# EAGLE schematic Resistor_Resistor (EAGLE 8.3.0), part 19 of 43
## Parts (continued)
R25858  10K  RESISTOR_0201  [0201]
R25859  10K  RESISTOR_0201  [0201]
R25860  10K  RESISTOR_0201  [0201]
R25861  10K  RESISTOR_0201  [0201]
R25862  10K  RESISTOR_0201  [0201]
R25863  10K  RESISTOR_0201  [0201]
R25864  10K  RESISTOR_0201  [0201]
R25865  10K  RESISTOR_0201  [0201]
R25866  10K  RESISTOR_0201  [0201]
R25867  10K  RESISTOR_0201  [0201]
R25868  10K  RESISTOR_0201  [0201]
R25869  10K  RESISTOR_0201  [0201]
R25870  10K  RESISTOR_0201  [0201]
R25871  10K  RESISTOR_0201  [0201]
R25872  10K  RESISTOR_0201  [0201]
R25873  10K  RESISTOR_0201  [0201]
R25874  10K  RESISTOR_0201  [0201]
R25875  10K  RESISTOR_0201  [0201]
R25876  10K  RESISTOR_0201  [0201]
R25877  10K  RESISTOR_0201  [0201]
R25878  10K  RESISTOR_0201  [0201]
R25879  10K  RESISTOR_0201  [0201]
R25880  10K  RESISTOR_0201  [0201]
R25881  10K  RESISTOR_0201  [0201]
R25882  10K  RESISTOR_0201  [0201]
R25883  10K  RESISTOR_0201  [0201]
R25884  10K  RESISTOR_0201  [0201]
R25885  10K  RESISTOR_0201  [0201]
R25886  10K  RESISTOR_0201  [0201]
R25887  10K  RESISTOR_0201  [0201]
R25888  10K  RESISTOR_0201  [0201]
R25889  10K  RESISTOR_0201  [0201]
R25890  10K  RESISTOR_0201  [0201]
R25891  10K  RESISTOR_0201  [0201]
R25892  10K  RESISTOR_0201  [0201]
R25893  10K  RESISTOR_0201  [0201]
R25894  10K  RESISTOR_0201  [0201]
R25895  10K  RESISTOR_0201  [0201]
R25896  10K  RESISTOR_0201  [0201]
R25897  10K  RESISTOR_0201  [0201]
R25898  10K  RESISTOR_0201  [0201]
R25899  10K  RESISTOR_0201  [0201]
R25900  10K  RESISTOR_0201  [0201]
R25901  10K  RESISTOR_0201  [0201]
R25902  10K  RESISTOR_0201  [0201]
R25903  10K  RESISTOR_0201  [0201]
R25904  10K  RESISTOR_0201  [0201]
R25905  10K  RESISTOR_0201  [0201]
R25906  10K  RESISTOR_0201  [0201]
R25907  10K  RESISTOR_0201  [0201]
R25908  10K  RESISTOR_0201  [0201]
R25909  10K  RESISTOR_0201  [0201]
R25910  10K  RESISTOR_0201  [0201]
R25911  10K  RESISTOR_0201  [0201]
R25912  10K  RESISTOR_0201  [0201]
R25913  10K  RESISTOR_0201  [0201]
R25914  10K  RESISTOR_0201  [0201]
R25915  10K  RESISTOR_0201  [0201]
R25916  10K  RESISTOR_0201  [0201]
R25917  10K  RESISTOR_0201  [0201]
R25918  10K  RESISTOR_0201  [0201]
R25919  10K  RESISTOR_0201  [0201]
R25920  10K  RESISTOR_0201  [0201]
R25921  10K  RESISTOR_0201  [0201]
R25922  10K  RESISTOR_0201  [0201]
R25923  10K  RESISTOR_0201  [0201]
R25924  10K  RESISTOR_0201  [0201]
R25925  10K  RESISTOR_0201  [0201]
R25926  10K  RESISTOR_0201  [0201]
R25927  10K  RESISTOR_0201  [0201]
R25928  10K  RESISTOR_0201  [0201]
R25929  10K  RESISTOR_0201  [0201]
R25930  10K  RESISTOR_0201  [0201]
R25931  10K  RESISTOR_0201  [0201]
R25932  10K  RESISTOR_0201  [0201]
R25933  10K  RESISTOR_0201  [0201]
R25934  10K  RESISTOR_0201  [0201]
R25935  10K  RESISTOR_0201  [0201]
R25936  10K  RESISTOR_0201  [0201]
R25937  10K  RESISTOR_0201  [0201]
R25938  10K  RESISTOR_0201  [0201]
R25939  10K  RESISTOR_0201  [0201]
R25940  10K  RESISTOR_0201  [0201]
R25941  10K  RESISTOR_0201  [0201]
R25942  10K  RESISTOR_0201  [0201]
R25943  10K  RESISTOR_0201  [0201]
R25944  10K  RESISTOR_0201  [0201]
R25945  10K  RESISTOR_0201  [0201]
R25946  10K  RESISTOR_0201  [0201]
R25947  10K  RESISTOR_0201  [0201]
R25948  10K  RESISTOR_0201  [0201]
R25949  10K  RESISTOR_0201  [0201]
R25950  10K  RESISTOR_0201  [0201]
R25951  10K  RESISTOR_0201  [0201]
R25952  10K  RESISTOR_0201  [0201]
R25953  10K  RESISTOR_0201  [0201]
R25954  10K  RESISTOR_0201  [0201]
R25955  10K  RESISTOR_0201  [0201]
R25956  10K  RESISTOR_0201  [0201]
R25957  10K  RESISTOR_0201  [0201]
R25958  10K  RESISTOR_0201  [0201]
R25959  10K  RESISTOR_0201  [0201]
R25960  10K  RESISTOR_0201  [0201]
R25961  10K  RESISTOR_0201  [0201]
R25962  10K  RESISTOR_0201  [0201]
R25963  10K  RESISTOR_0201  [0201]
R25964  10K  RESISTOR_0201  [0201]
R25965  10K  RESISTOR_0201  [0201]
R25966  10K  RESISTOR_0201  [0201]
R25967  10K  RESISTOR_0201  [0201]
R25968  10K  RESISTOR_0201  [0201]
R25969  10K  RESISTOR_0201  [0201]
R25970  10K  RESISTOR_0201  [0201]
R25971  10K  RESISTOR_0201  [0201]
R25972  10K  RESISTOR_0201  [0201]
R25973  10K  RESISTOR_0201  [0201]
R25974  10K  RESISTOR_0201  [0201]
R25975  10K  RESISTOR_0201  [0201]
R25976  10K  RESISTOR_0201  [0201]
R25977  10K  RESISTOR_0201  [0201]
R25978  10K  RESISTOR_0201  [0201]
R25979  10K  RESISTOR_0201  [0201]
R25980  10K  RESISTOR_0201  [0201]
R25981  10K  RESISTOR_0201  [0201]
R25982  10K  RESISTOR_0201  [0201]
R25983  10K  RESISTOR_0201  [0201]
R25984  10K  RESISTOR_0201  [0201]
R25985  10K  RESISTOR_0201  [0201]
R25986  10K  RESISTOR_0201  [0201]
R25987  10K  RESISTOR_0201  [0201]
R25988  10K  RESISTOR_0201  [0201]
R25989  10K  RESISTOR_0201  [0201]
R25990  10K  RESISTOR_0201  [0201]
R25991  10K  RESISTOR_0201  [0201]
R25992  10K  RESISTOR_0201  [0201]
R25993  10K  RESISTOR_0201  [0201]
R25994  10K  RESISTOR_0201  [0201]
R25995  10K  RESISTOR_0201  [0201]
R25996  10K  RESISTOR_0201  [0201]
R25997  10K  RESISTOR_0201  [0201]
R25998  10K  RESISTOR_0201  [0201]
R25999  10K  RESISTOR_0201  [0201]
R26000  10K  RESISTOR_0201  [0201]
R26001  10K  RESISTOR_0201  [0201]
R26002  10K  RESISTOR_0201  [0201]
R26003  10K  RESISTOR_0201  [0201]
R26004  10K  RESISTOR_0201  [0201]
R26005  10K  RESISTOR_0201  [0201]
R26006  10K  RESISTOR_0201  [0201]
R26007  10K  RESISTOR_0201  [0201]
R26008  10K  RESISTOR_0201  [0201]
R26009  10K  RESISTOR_0201  [0201]
R26010  10K  RESISTOR_0201  [0201]
R26011  10K  RESISTOR_0201  [0201]
R26012  10K  RESISTOR_0201  [0201]
R26013  10K  RESISTOR_0201  [0201]
R26014  10K  RESISTOR_0201  [0201]
R26015  10K  RESISTOR_0201  [0201]
R26016  10K  RESISTOR_0201  [0201]
R26017  10K  RESISTOR_0201  [0201]
R26018  10K  RESISTOR_0201  [0201]
R26019  10K  RESISTOR_0201  [0201]
R26020  10K  RESISTOR_0201  [0201]
R26021  10K  RESISTOR_0201  [0201]
R26022  10K  RESISTOR_0201  [0201]
R26023  10K  RESISTOR_0201  [0201]
R26024  10K  RESISTOR_0201  [0201]
R26025  10K  RESISTOR_0201  [0201]
R26026  10K  RESISTOR_0201  [0201]
R26027  10K  RESISTOR_0201  [0201]
R26028  10K  RESISTOR_0201  [0201]
R26029  10K  RESISTOR_0201  [0201]
R26030  10K  RESISTOR_0201  [0201]
R26031  10K  RESISTOR_0201  [0201]
R26032  10K  RESISTOR_0201  [0201]
R26033  10K  RESISTOR_0201  [0201]
R26034  10K  RESISTOR_0201  [0201]
R26035  10K  RESISTOR_0201  [0201]
R26036  10K  RESISTOR_0201  [0201]
R26037  10K  RESISTOR_0201  [0201]
R26038  10K  RESISTOR_0201  [0201]
R26039  10K  RESISTOR_0201  [0201]
R26040  10K  RESISTOR_0201  [0201]
R26041  10K  RESISTOR_0201  [0201]
R26042  10K  RESISTOR_0201  [0201]
R26043  10K  RESISTOR_0201  [0201]
R26044  10K  RESISTOR_0201  [0201]
R26045  10K  RESISTOR_0201  [0201]
R26046  10K  RESISTOR_0201  [0201]
R26047  10K  RESISTOR_0201  [0201]
R26048  10K  RESISTOR_0201  [0201]
R26049  10K  RESISTOR_0201  [0201]
R26050  10K  RESISTOR_0201  [0201]
R26051  10K  RESISTOR_0201  [0201]
R26052  10K  RESISTOR_0201  [0201]
R26053  10K  RESISTOR_0201  [0201]
R26054  10K  RESISTOR_0201  [0201]
R26055  10K  RESISTOR_0201  [0201]
R26056  10K  RESISTOR_0201  [0201]
R26057  10K  RESISTOR_0201  [0201]
R26058  10K  RESISTOR_0201  [0201]
R26059  10K  RESISTOR_0201  [0201]
R26060  10K  RESISTOR_0201  [0201]
R26061  10K  RESISTOR_0201  [0201]
R26062  10K  RESISTOR_0201  [0201]
R26063  10K  RESISTOR_0201  [0201]
R26064  10K  RESISTOR_0201  [0201]
R26065  10K  RESISTOR_0201  [0201]
R26066  10K  RESISTOR_0201  [0201]
R26067  10K  RESISTOR_0201  [0201]
R26068  10K  RESISTOR_0201  [0201]
R26069  10K  RESISTOR_0201  [0201]
R26070  10K  RESISTOR_0201  [0201]
R26071  10K  RESISTOR_0201  [0201]
R26072  10K  RESISTOR_0201  [0201]
R26073  10K  RESISTOR_0201  [0201]
R26074  10K  RESISTOR_0201  [0201]
R26075  10K  RESISTOR_0201  [0201]
R26076  10K  RESISTOR_0201  [0201]
R26077  10K  RESISTOR_0201  [0201]
R26078  10K  RESISTOR_0201  [0201]
R26079  10K  RESISTOR_0201  [0201]
R26080  10K  RESISTOR_0201  [0201]
R26081  10K  RESISTOR_0201  [0201]
R26082  10K  RESISTOR_0201  [0201]
R26083  10K  RESISTOR_0201  [0201]
R26084  10K  RESISTOR_0201  [0201]
R26085  10K  RESISTOR_0201  [0201]
R26086  10K  RESISTOR_0201  [0201]
R26087  10K  RESISTOR_0201  [0201]
R26088  10K  RESISTOR_0201  [0201]
R26089  10K  RESISTOR_0201  [0201]
R26090  10K  RESISTOR_0201  [0201]
R26091  10K  RESISTOR_0201  [0201]
R26092  10K  RESISTOR_0201  [0201]
R26093  10K  RESISTOR_0201  [0201]
R26094  10K  RESISTOR_0201  [0201]
R26095  10K  RESISTOR_0201  [0201]
R26096  10K  RESISTOR_0201  [0201]
R26097  10K  RESISTOR_0201  [0201]
R26098  10K  RESISTOR_0201  [0201]
R26099  10K  RESISTOR_0201  [0201]
R26100  10K  RESISTOR_0201  [0201]
R26101  10K  RESISTOR_0201  [0201]
R26102  10K  RESISTOR_0201  [0201]
R26103  10K  RESISTOR_0201  [0201]
R26104  10K  RESISTOR_0201  [0201]
R26105  10K  RESISTOR_0201  [0201]
R26106  10K  RESISTOR_0201  [0201]
R26107  10K  RESISTOR_0201  [0201]
R26108  10K  RESISTOR_0201  [0201]
R26109  10K  RESISTOR_0201  [0201]
R26110  10K  RESISTOR_0201  [0201]
R26111  10K  RESISTOR_0201  [0201]
R26112  10K  RESISTOR_0201  [0201]
R26113  10K  RESISTOR_0201  [0201]
R26114  10K  RESISTOR_0201  [0201]
R26115  10K  RESISTOR_0201  [0201]
R26116  10K  RESISTOR_0201  [0201]
R26117  10K  RESISTOR_0201  [0201]
R26118  10K  RESISTOR_0201  [0201]
R26119  10K  RESISTOR_0201  [0201]
R26120  10K  RESISTOR_0201  [0201]
R26121  10K  RESISTOR_0201  [0201]
R26122  10K  RESISTOR_0201  [0201]
R26123  10K  RESISTOR_0201  [0201]
R26124  10K  RESISTOR_0201  [0201]
R26125  10K  RESISTOR_0201  [0201]
R26126  10K  RESISTOR_0201  [0201]
R26127  10K  RESISTOR_0201  [0201]
R26128  10K  RESISTOR_0201  [0201]
R26129  10K  RESISTOR_0201  [0201]
R26130  10K  RESISTOR_0201  [0201]
R26131  10K  RESISTOR_0201  [0201]
R26132  10K  RESISTOR_0201  [0201]
R26133  10K  RESISTOR_0201  [0201]
R26134  10K  RESISTOR_0201  [0201]
R26135  10K  RESISTOR_0201  [0201]
R26136  10K  RESISTOR_0201  [0201]
R26137  10K  RESISTOR_0201  [0201]
R26138  10K  RESISTOR_0201  [0201]
R26139  10K  RESISTOR_0201  [0201]
R26140  10K  RESISTOR_0201  [0201]
R26141  10K  RESISTOR_0201  [0201]
R26142  10K  RESISTOR_0201  [0201]
R26143  10K  RESISTOR_0201  [0201]
R26144  10K  RESISTOR_0201  [0201]
R26145  10K  RESISTOR_0201  [0201]
R26146  10K  RESISTOR_0201  [0201]
R26147  10K  RESISTOR_0201  [0201]
R26148  10K  RESISTOR_0201  [0201]
R26149  10K  RESISTOR_0201  [0201]
R26150  10K  RESISTOR_0201  [0201]
R26151  10K  RESISTOR_0201  [0201]
R26152  10K  RESISTOR_0201  [0201]
R26153  10K  RESISTOR_0201  [0201]
R26154  10K  RESISTOR_0201  [0201]
R26155  10K  RESISTOR_0201  [0201]
R26156  10K  RESISTOR_0201  [0201]
R26157  10K  RESISTOR_0201  [0201]
R26158  10K  RESISTOR_0201  [0201]
R26159  10K  RESISTOR_0201  [0201]
R26160  10K  RESISTOR_0201  [0201]
R26161  10K  RESISTOR_0201  [0201]
R26162  10K  RESISTOR_0201  [0201]
R26163  10K  RESISTOR_0201  [0201]
R26164  10K  RESISTOR_0201  [0201]
R26165  10K  RESISTOR_0201  [0201]
R26166  10K  RESISTOR_0201  [0201]
R26167  10K  RESISTOR_0201  [0201]
R26168  10K  RESISTOR_0201  [0201]
R26169  10K  RESISTOR_0201  [0201]
R26170  10K  RESISTOR_0201  [0201]
R26171  10K  RESISTOR_0201  [0201]
R26172  10K  RESISTOR_0201  [0201]
R26173  10K  RESISTOR_0201  [0201]
R26174  10K  RESISTOR_0201  [0201]
R26175  10K  RESISTOR_0201  [0201]
R26176  10K  RESISTOR_0201  [0201]
R26177  10K  RESISTOR_0201  [0201]
R26178  10K  RESISTOR_0201  [0201]
R26179  10K  RESISTOR_0201  [0201]
R26180  10K  RESISTOR_0201  [0201]
R26181  10K  RESISTOR_0201  [0201]
R26182  10K  RESISTOR_0201  [0201]
R26183  10K  RESISTOR_0201  [0201]
R26184  10K  RESISTOR_0201  [0201]
R26185  10K  RESISTOR_0201  [0201]
R26186  10K  RESISTOR_0201  [0201]
R26187  10K  RESISTOR_0201  [0201]
R26188  10K  RESISTOR_0201  [0201]
R26189  10K  RESISTOR_0201  [0201]
R26190  10K  RESISTOR_0201  [0201]
R26191  10K  RESISTOR_0201  [0201]
R26192  10K  RESISTOR_0201  [0201]
R26193  10K  RESISTOR_0201  [0201]
R26194  10K  RESISTOR_0201  [0201]
R26195  10K  RESISTOR_0201  [0201]
R26196  10K  RESISTOR_0201  [0201]
R26197  10K  RESISTOR_0201  [0201]
R26198  10K  RESISTOR_0201  [0201]
R26199  10K  RESISTOR_0201  [0201]
R26200  10K  RESISTOR_0201  [0201]
R26201  10K  RESISTOR_0201  [0201]
R26202  10K  RESISTOR_0201  [0201]
R26203  10K  RESISTOR_0201  [0201]
R26204  10K  RESISTOR_0201  [0201]
R26205  10K  RESISTOR_0201  [0201]
R26206  10K  RESISTOR_0201  [0201]
R26207  10K  RESISTOR_0201  [0201]
R26208  10K  RESISTOR_0201  [0201]
R26209  10K  RESISTOR_0201  [0201]
R26210  10K  RESISTOR_0201  [0201]
R26211  10K  RESISTOR_0201  [0201]
R26212  10K  RESISTOR_0201  [0201]
R26213  10K  RESISTOR_0201  [0201]
R26214  10K  RESISTOR_0201  [0201]
R26215  10K  RESISTOR_0201  [0201]
R26216  10K  RESISTOR_0201  [0201]
R26217  10K  RESISTOR_0201  [0201]
R26218  10K  RESISTOR_0201  [0201]
R26219  10K  RESISTOR_0201  [0201]
R26220  10K  RESISTOR_0201  [0201]
R26221  10K  RESISTOR_0201  [0201]
R26222  10K  RESISTOR_0201  [0201]
R26223  10K  RESISTOR_0201  [0201]
R26224  10K  RESISTOR_0201  [0201]
R26225  10K  RESISTOR_0201  [0201]
R26226  10K  RESISTOR_0201  [0201]
R26227  10K  RESISTOR_0201  [0201]
R26228  10K  RESISTOR_0201  [0201]
R26229  10K  RESISTOR_0201  [0201]
R26230  10K  RESISTOR_0201  [0201]
R26231  10K  RESISTOR_0201  [0201]
R26232  10K  RESISTOR_0201  [0201]
R26233  10K  RESISTOR_0201  [0201]
R26234  10K  RESISTOR_0201  [0201]
R26235  10K  RESISTOR_0201  [0201]
R26236  10K  RESISTOR_0201  [0201]
R26237  10K  RESISTOR_0201  [0201]
R26238  10K  RESISTOR_0201  [0201]
R26239  10K  RESISTOR_0201  [0201]
R26240  10K  RESISTOR_0201  [0201]
R26241  10K  RESISTOR_0201  [0201]
R26242  10K  RESISTOR_0201  [0201]
R26243  10K  RESISTOR_0201  [0201]
R26244  10K  RESISTOR_0201  [0201]
R26245  10K  RESISTOR_0201  [0201]
R26246  10K  RESISTOR_0201  [0201]
R26247  10K  RESISTOR_0201  [0201]
R26248  10K  RESISTOR_0201  [0201]
R26249  10K  RESISTOR_0201  [0201]
R26250  10K  RESISTOR_0201  [0201]
R26251  10K  RESISTOR_0201  [0201]
R26252  10K  RESISTOR_0201  [0201]
R26253  10K  RESISTOR_0201  [0201]
R26254  10K  RESISTOR_0201  [0201]
R26255  10K  RESISTOR_0201  [0201]
R26256  10K  RESISTOR_0201  [0201]
R26257  10K  RESISTOR_0201  [0201]
R26258  10K  RESISTOR_0201  [0201]
R26259  10K  RESISTOR_0201  [0201]
R26260  10K  RESISTOR_0201  [0201]
R26261  10K  RESISTOR_0201  [0201]
R26262  10K  RESISTOR_0201  [0201]
R26263  10K  RESISTOR_0201  [0201]
R26264  10K  RESISTOR_0201  [0201]
R26265  10K  RESISTOR_0201  [0201]
R26266  10K  RESISTOR_0201  [0201]
R26267  10K  RESISTOR_0201  [0201]
R26268  10K  RESISTOR_0201  [0201]
R26269  10K  RESISTOR_0201  [0201]
R26270  10K  RESISTOR_0201  [0201]
R26271  10K  RESISTOR_0201  [0201]
R26272  10K  RESISTOR_0201  [0201]
R26273  10K  RESISTOR_0201  [0201]
R26274  10K  RESISTOR_0201  [0201]
R26275  10K  RESISTOR_0201  [0201]
R26276  10K  RESISTOR_0201  [0201]
R26277  10K  RESISTOR_0201  [0201]
R26278  10K  RESISTOR_0201  [0201]
R26279  10K  RESISTOR_0201  [0201]
R26280  10K  RESISTOR_0201  [0201]
R26281  10K  RESISTOR_0201  [0201]
R26282  10K  RESISTOR_0201  [0201]
R26283  10K  RESISTOR_0201  [0201]
R26284  10K  RESISTOR_0201  [0201]
R26285  10K  RESISTOR_0201  [0201]
R26286  10K  RESISTOR_0201  [0201]
R26287  10K  RESISTOR_0201  [0201]
R26288  10K  RESISTOR_0201  [0201]
R26289  10K  RESISTOR_0201  [0201]
R26290  10K  RESISTOR_0201  [0201]
R26291  10K  RESISTOR_0201  [0201]
R26292  10K  RESISTOR_0201  [0201]
R26293  10K  RESISTOR_0201  [0201]
R26294  10K  RESISTOR_0201  [0201]
R26295  10K  RESISTOR_0201  [0201]
R26296  10K  RESISTOR_0201  [0201]
R26297  10K  RESISTOR_0201  [0201]
R26298  10K  RESISTOR_0201  [0201]
R26299  10K  RESISTOR_0201  [0201]
R26300  10K  RESISTOR_0201  [0201]
R26301  10K  RESISTOR_0201  [0201]
R26302  10K  RESISTOR_0201  [0201]
R26303  10K  RESISTOR_0201  [0201]
R26304  10K  RESISTOR_0201  [0201]
R26305  10K  RESISTOR_0201  [0201]
R26306  10K  RESISTOR_0201  [0201]
R26307  10K  RESISTOR_0201  [0201]
R26308  10K  RESISTOR_0201  [0201]
R26309  10K  RESISTOR_0201  [0201]
R26310  10K  RESISTOR_0201  [0201]
R26311  10K  RESISTOR_0201  [0201]
R26312  10K  RESISTOR_0201  [0201]
R26313  10K  RESISTOR_0201  [0201]
R26314  10K  RESISTOR_0201  [0201]
R26315  10K  RESISTOR_0201  [0201]
R26316  10K  RESISTOR_0201  [0201]
R26317  10K  RESISTOR_0201  [0201]
R26318  10K  RESISTOR_0201  [0201]
R26319  10K  RESISTOR_0201  [0201]
R26320  10K  RESISTOR_0201  [0201]
R26321  10K  RESISTOR_0201  [0201]
R26322  10K  RESISTOR_0201  [0201]
R26323  10K  RESISTOR_0201  [0201]
R26324  10K  RESISTOR_0201  [0201]
R26325  10K  RESISTOR_0201  [0201]
R26326  10K  RESISTOR_0201  [0201]
R26327  10K  RESISTOR_0201  [0201]
R26328  10K  RESISTOR_0201  [0201]
R26329  10K  RESISTOR_0201  [0201]
R26330  10K  RESISTOR_0201  [0201]
R26331  10K  RESISTOR_0201  [0201]
R26332  10K  RESISTOR_0201  [0201]
R26333  10K  RESISTOR_0201  [0201]
R26334  10K  RESISTOR_0201  [0201]
R26335  10K  RESISTOR_0201  [0201]
R26336  10K  RESISTOR_0201  [0201]
R26337  10K  RESISTOR_0201  [0201]
R26338  10K  RESISTOR_0201  [0201]
R26339  10K  RESISTOR_0201  [0201]
R26340  10K  RESISTOR_0201  [0201]
R26341  10K  RESISTOR_0201  [0201]
R26342  10K  RESISTOR_0201  [0201]
R26343  10K  RESISTOR_0201  [0201]
R26344  10K  RESISTOR_0201  [0201]
R26345  10K  RESISTOR_0201  [0201]
R26346  10K  RESISTOR_0201  [0201]
R26347  10K  RESISTOR_0201  [0201]
R26348  10K  RESISTOR_0201  [0201]
R26349  10K  RESISTOR_0201  [0201]
R26350  10K  RESISTOR_0201  [0201]
R26351  10K  RESISTOR_0201  [0201]
R26352  10K  RESISTOR_0201  [0201]
R26353  10K  RESISTOR_0201  [0201]
R26354  10K  RESISTOR_0201  [0201]
R26355  10K  RESISTOR_0201  [0201]
R26356  10K  RESISTOR_0201  [0201]
R26357  10K  RESISTOR_0201  [0201]
R26358  10K  RESISTOR_0201  [0201]
R26359  10K  RESISTOR_0201  [0201]
R26360  10K  RESISTOR_0201  [0201]
R26361  10K  RESISTOR_0201  [0201]
R26362  10K  RESISTOR_0201  [0201]
R26363  10K  RESISTOR_0201  [0201]
R26364  10K  RESISTOR_0201  [0201]
R26365  10K  RESISTOR_0201  [0201]
R26366  10K  RESISTOR_0201  [0201]
R26367  10K  RESISTOR_0201  [0201]
R26368  10K  RESISTOR_0201  [0201]
R26369  10K  RESISTOR_0201  [0201]
R26370  10K  RESISTOR_0201  [0201]
R26371  10K  RESISTOR_0201  [0201]
R26372  10K  RESISTOR_0201  [0201]
R26373  10K  RESISTOR_0201  [0201]
R26374  10K  RESISTOR_0201  [0201]
R26375  10K  RESISTOR_0201  [0201]
R26376  10K  RESISTOR_0201  [0201]
R26377  10K  RESISTOR_0201  [0201]
R26378  10K  RESISTOR_0201  [0201]
R26379  10K  RESISTOR_0201  [0201]
R26380  10K  RESISTOR_0201  [0201]
R26381  10K  RESISTOR_0201  [0201]
R26382  10K  RESISTOR_0201  [0201]
R26383  10K  RESISTOR_0201  [0201]
R26384  10K  RESISTOR_0201  [0201]
R26385  10K  RESISTOR_0201  [0201]
R26386  10K  RESISTOR_0201  [0201]
R26387  10K  RESISTOR_0201  [0201]
R26388  10K  RESISTOR_0201  [0201]
R26389  10K  RESISTOR_0201  [0201]
R26390  10K  RESISTOR_0201  [0201]
R26391  10K  RESISTOR_0201  [0201]
R26392  10K  RESISTOR_0201  [0201]
R26393  10K  RESISTOR_0201  [0201]
R26394  10K  RESISTOR_0201  [0201]
R26395  10K  RESISTOR_0201  [0201]
R26396  10K  RESISTOR_0201  [0201]
R26397  10K  RESISTOR_0201  [0201]
R26398  10K  RESISTOR_0201  [0201]
R26399  10K  RESISTOR_0201  [0201]
R26400  10K  RESISTOR_0201  [0201]
R26401  10K  RESISTOR_0201  [0201]
R26402  10K  RESISTOR_0201  [0201]
R26403  10K  RESISTOR_0201  [0201]
R26404  10K  RESISTOR_0201  [0201]
R26405  10K  RESISTOR_0201  [0201]
R26406  10K  RESISTOR_0201  [0201]
R26407  10K  RESISTOR_0201  [0201]
R26408  10K  RESISTOR_0201  [0201]
R26409  10K  RESISTOR_0201  [0201]
R26410  10K  RESISTOR_0201  [0201]
R26411  10K  RESISTOR_0201  [0201]
R26412  10K  RESISTOR_0201  [0201]
R26413  10K  RESISTOR_0201  [0201]
R26414  10K  RESISTOR_0201  [0201]
R26415  10K  RESISTOR_0201  [0201]
R26416  10K  RESISTOR_0201  [0201]
R26417  10K  RESISTOR_0201  [0201]
R26418  10K  RESISTOR_0201  [0201]
R26419  10K  RESISTOR_0201  [0201]
R26420  10K  RESISTOR_0201  [0201]
R26421  10K  RESISTOR_0201  [0201]
R26422  10K  RESISTOR_0201  [0201]
R26423  10K  RESISTOR_0201  [0201]
R26424  10K  RESISTOR_0201  [0201]
R26425  10K  RESISTOR_0201  [0201]
R26426  10K  RESISTOR_0201  [0201]
R26427  10K  RESISTOR_0201  [0201]
R26428  10K  RESISTOR_0201  [0201]
R26429  10K  RESISTOR_0201  [0201]
R26430  10K  RESISTOR_0201  [0201]
R26431  10K  RESISTOR_0201  [0201]
R26432  10K  RESISTOR_0201  [0201]
R26433  10K  RESISTOR_0201  [0201]
R26434  10K  RESISTOR_0201  [0201]
R26435  10K  RESISTOR_0201  [0201]
R26436  10K  RESISTOR_0201  [0201]
R26437  10K  RESISTOR_0201  [0201]
R26438  10K  RESISTOR_0201  [0201]
R26439  10K  RESISTOR_0201  [0201]
R26440  10K  RESISTOR_0201  [0201]
R26441  10K  RESISTOR_0201  [0201]
R26442  10K  RESISTOR_0201  [0201]
R26443  10K  RESISTOR_0201  [0201]
R26444  10K  RESISTOR_0201  [0201]
R26445  10K  RESISTOR_0201  [0201]
R26446  10K  RESISTOR_0201  [0201]
R26447  10K  RESISTOR_0201  [0201]
R26448  10K  RESISTOR_0201  [0201]
R26449  10K  RESISTOR_0201  [0201]
R26450  10K  RESISTOR_0201  [0201]
R26451  10K  RESISTOR_0201  [0201]
R26452  10K  RESISTOR_0201  [0201]
R26453  10K  RESISTOR_0201  [0201]
R26454  10K  RESISTOR_0201  [0201]
R26455  10K  RESISTOR_0201  [0201]
R26456  10K  RESISTOR_0201  [0201]
R26457  10K  RESISTOR_0201  [0201]
R26458  10K  RESISTOR_0201  [0201]
R26459  10K  RESISTOR_0201  [0201]
R26460  10K  RESISTOR_0201  [0201]
R26461  10K  RESISTOR_0201  [0201]
R26462  10K  RESISTOR_0201  [0201]
R26463  10K  RESISTOR_0201  [0201]
R26464  10K  RESISTOR_0201  [0201]
R26465  10K  RESISTOR_0201  [0201]
R26466  10K  RESISTOR_0201  [0201]
R26467  10K  RESISTOR_0201  [0201]
R26468  10K  RESISTOR_0201  [0201]
R26469  10K  RESISTOR_0201  [0201]
R26470  10K  RESISTOR_0201  [0201]
R26471  10K  RESISTOR_0201  [0201]
R26472  10K  RESISTOR_0201  [0201]
R26473  10K  RESISTOR_0201  [0201]
R26474  10K  RESISTOR_0201  [0201]
R26475  10K  RESISTOR_0201  [0201]
R26476  10K  RESISTOR_0201  [0201]
R26477  10K  RESISTOR_0201  [0201]
R26478  10K  RESISTOR_0201  [0201]
R26479  10K  RESISTOR_0201  [0201]
R26480  10K  RESISTOR_0201  [0201]
R26481  10K  RESISTOR_0201  [0201]
R26482  10K  RESISTOR_0201  [0201]
R26483  10K  RESISTOR_0201  [0201]
R26484  10K  RESISTOR_0201  [0201]
R26485  10K  RESISTOR_0201  [0201]
R26486  10K  RESISTOR_0201  [0201]
R26487  10K  RESISTOR_0201  [0201]
R26488  10K  RESISTOR_0201  [0201]
R26489  10K  RESISTOR_0201  [0201]
R26490  10K  RESISTOR_0201  [0201]
R26491  10K  RESISTOR_0201  [0201]
R26492  10K  RESISTOR_0201  [0201]
R26493  10K  RESISTOR_0201  [0201]
R26494  10K  RESISTOR_0201  [0201]
R26495  10K  RESISTOR_0201  [0201]
R26496  10K  RESISTOR_0201  [0201]
R26497  10K  RESISTOR_0201  [0201]
R26498  10K  RESISTOR_0201  [0201]
R26499  10K  RESISTOR_0201  [0201]
R26500  10K  RESISTOR_0201  [0201]
R26501  10K  RESISTOR_0201  [0201]
R26502  10K  RESISTOR_0201  [0201]
R26503  10K  RESISTOR_0201  [0201]
R26504  10K  RESISTOR_0201  [0201]
R26505  10K  RESISTOR_0201  [0201]
R26506  10K  RESISTOR_0201  [0201]
R26507  10K  RESISTOR_0201  [0201]
R26508  10K  RESISTOR_0201  [0201]
R26509  10K  RESISTOR_0201  [0201]
R26510  10K  RESISTOR_0201  [0201]
R26511  10K  RESISTOR_0201  [0201]
R26512  10K  RESISTOR_0201  [0201]
R26513  10K  RESISTOR_0201  [0201]
R26514  10K  RESISTOR_0201  [0201]
R26515  10K  RESISTOR_0201  [0201]
R26516  10K  RESISTOR_0201  [0201]
R26517  10K  RESISTOR_0201  [0201]
R26518  10K  RESISTOR_0201  [0201]
R26519  10K  RESISTOR_0201  [0201]
R26520  10K  RESISTOR_0201  [0201]
R26521  10K  RESISTOR_0201  [0201]
R26522  10K  RESISTOR_0201  [0201]
R26523  10K  RESISTOR_0201  [0201]
R26524  10K  RESISTOR_0201  [0201]
R26525  10K  RESISTOR_0201  [0201]
R26526  10K  RESISTOR_0201  [0201]
R26527  10K  RESISTOR_0201  [0201]
R26528  10K  RESISTOR_0201  [0201]
R26529  10K  RESISTOR_0201  [0201]
R26530  10K  RESISTOR_0201  [0201]
R26531  10K  RESISTOR_0201  [0201]
R26532  10K  RESISTOR_0201  [0201]
R26533  10K  RESISTOR_0201  [0201]
R26534  10K  RESISTOR_0201  [0201]
R26535  10K  RESISTOR_0201  [0201]
R26536  10K  RESISTOR_0201  [0201]
R26537  10K  RESISTOR_0201  [0201]
R26538  10K  RESISTOR_0201  [0201]
R26539  10K  RESISTOR_0201  [0201]
R26540  10K  RESISTOR_0201  [0201]
R26541  10K  RESISTOR_0201  [0201]
R26542  10K  RESISTOR_0201  [0201]
R26543  10K  RESISTOR_0201  [0201]
R26544  10K  RESISTOR_0201  [0201]
R26545  10K  RESISTOR_0201  [0201]
R26546  10K  RESISTOR_0201  [0201]
R26547  10K  RESISTOR_0201  [0201]
R26548  10K  RESISTOR_0201  [0201]
R26549  10K  RESISTOR_0201  [0201]
R26550  10K  RESISTOR_0201  [0201]
R26551  10K  RESISTOR_0201  [0201]
R26552  10K  RESISTOR_0201  [0201]
R26553  10K  RESISTOR_0201  [0201]
R26554  10K  RESISTOR_0201  [0201]
R26555  10K  RESISTOR_0201  [0201]
R26556  10K  RESISTOR_0201  [0201]
R26557  10K  RESISTOR_0201  [0201]
R26558  10K  RESISTOR_0201  [0201]
R26559  10K  RESISTOR_0201  [0201]
R26560  10K  RESISTOR_0201  [0201]
R26561  10K  RESISTOR_0201  [0201]
R26562  10K  RESISTOR_0201  [0201]
R26563  10K  RESISTOR_0201  [0201]
R26564  10K  RESISTOR_0201  [0201]
R26565  10K  RESISTOR_0201  [0201]
R26566  10K  RESISTOR_0201  [0201]
R26567  10K  RESISTOR_0201  [0201]
R26568  10K  RESISTOR_0201  [0201]
R26569  10K  RESISTOR_0201  [0201]
R26570  10K  RESISTOR_0201  [0201]
R26571  10K  RESISTOR_0201  [0201]
R26572  10K  RESISTOR_0201  [0201]
R26573  10K  RESISTOR_0201  [0201]
R26574  10K  RESISTOR_0201  [0201]
R26575  10K  RESISTOR_0201  [0201]
R26576  10K  RESISTOR_0201  [0201]
R26577  10K  RESISTOR_0201  [0201]
R26578  10K  RESISTOR_0201  [0201]
R26579  10K  RESISTOR_0201  [0201]
R26580  10K  RESISTOR_0201  [0201]
R26581  10K  RESISTOR_0201  [0201]
R26582  10K  RESISTOR_0201  [0201]
R26583  10K  RESISTOR_0201  [0201]
R26584  10K  RESISTOR_0201  [0201]
R26585  10K  RESISTOR_0201  [0201]
R26586  10K  RESISTOR_0201  [0201]
R26587  10K  RESISTOR_0201  [0201]
R26588  10K  RESISTOR_0201  [0201]
R26589  10K  RESISTOR_0201  [0201]
R26590  10K  RESISTOR_0201  [0201]
R26591  10K  RESISTOR_0201  [0201]
R26592  10K  RESISTOR_0201  [0201]
R26593  10K  RESISTOR_0201  [0201]
R26594  10K  RESISTOR_0201  [0201]
R26595  10K  RESISTOR_0201  [0201]
R26596  10K  RESISTOR_0201  [0201]
R26597  10K  RESISTOR_0201  [0201]
R26598  10K  RESISTOR_0201  [0201]
R26599  10K  RESISTOR_0201  [0201]
R26600  10K  RESISTOR_0201  [0201]
R26601  10K  RESISTOR_0201  [0201]
R26602  10K  RESISTOR_0201  [0201]
R26603  10K  RESISTOR_0201  [0201]
R26604  10K  RESISTOR_0201  [0201]
R26605  10K  RESISTOR_0201  [0201]
R26606  10K  RESISTOR_0201  [0201]
R26607  10K  RESISTOR_0201  [0201]
R26608  10K  RESISTOR_0201  [0201]
R26609  10K  RESISTOR_0201  [0201]
R26610  10K  RESISTOR_0201  [0201]
R26611  10K  RESISTOR_0201  [0201]
R26612  10K  RESISTOR_0201  [0201]
R26613  10K  RESISTOR_0201  [0201]
R26614  10K  RESISTOR_0201  [0201]
R26615  10K  RESISTOR_0201  [0201]
R26616  10K  RESISTOR_0201  [0201]
R26617  10K  RESISTOR_0201  [0201]
R26618  10K  RESISTOR_0201  [0201]
R26619  10K  RESISTOR_0201  [0201]
R26620  10K  RESISTOR_0201  [0201]
R26621  10K  RESISTOR_0201  [0201]
R26622  10K  RESISTOR_0201  [0201]
R26623  10K  RESISTOR_0201  [0201]
R26624  10K  RESISTOR_0201  [0201]
R26625  10K  RESISTOR_0201  [0201]
R26626  10K  RESISTOR_0201  [0201]
R26627  10K  RESISTOR_0201  [0201]
R26628  10K  RESISTOR_0201  [0201]
R26629  10K  RESISTOR_0201  [0201]
R26630  10K  RESISTOR_0201  [0201]
R26631  10K  RESISTOR_0201  [0201]
R26632  10K  RESISTOR_0201  [0201]
R26633  10K  RESISTOR_0201  [0201]
R26634  10K  RESISTOR_0201  [0201]
R26635  10K  RESISTOR_0201  [0201]
R26636  10K  RESISTOR_0201  [0201]
R26637  10K  RESISTOR_0201  [0201]
R26638  10K  RESISTOR_0201  [0201]
R26639  10K  RESISTOR_0201  [0201]
R26640  10K  RESISTOR_0201  [0201]
R26641  10K  RESISTOR_0201  [0201]
R26642  10K  RESISTOR_0201  [0201]
R26643  10K  RESISTOR_0201  [0201]
R26644  10K  RESISTOR_0201  [0201]
R26645  10K  RESISTOR_0201  [0201]
R26646  10K  RESISTOR_0201  [0201]
R26647  10K  RESISTOR_0201  [0201]
R26648  10K  RESISTOR_0201  [0201]
R26649  10K  RESISTOR_0201  [0201]
R26650  10K  RESISTOR_0201  [0201]
R26651  10K  RESISTOR_0201  [0201]
R26652  10K  RESISTOR_0201  [0201]
R26653  10K  RESISTOR_0201  [0201]
R26654  10K  RESISTOR_0201  [0201]
R26655  10K  RESISTOR_0201  [0201]
R26656  10K  RESISTOR_0201  [0201]
R26657  10K  RESISTOR_0201  [0201]
R26658  10K  RESISTOR_0201  [0201]
R26659  10K  RESISTOR_0201  [0201]
R26660  10K  RESISTOR_0201  [0201]
R26661  10K  RESISTOR_0201  [0201]
R26662  10K  RESISTOR_0201  [0201]
R26663  10K  RESISTOR_0201  [0201]
R26664  10K  RESISTOR_0201  [0201]
R26665  10K  RESISTOR_0201  [0201]
R26666  10K  RESISTOR_0201  [0201]
R26667  10K  RESISTOR_0201  [0201]
R26668  10K  RESISTOR_0201  [0201]
R26669  10K  RESISTOR_0201  [0201]
R26670  10K  RESISTOR_0201  [0201]
R26671  10K  RESISTOR_0201  [0201]
R26672  10K  RESISTOR_0201  [0201]
R26673  10K  RESISTOR_0201  [0201]
R26674  10K  RESISTOR_0201  [0201]
R26675  10K  RESISTOR_0201  [0201]
R26676  10K  RESISTOR_0201  [0201]
R26677  10K  RESISTOR_0201  [0201]
R26678  10K  RESISTOR_0201  [0201]
R26679  10K  RESISTOR_0201  [0201]
R26680  10K  RESISTOR_0201  [0201]
R26681  10K  RESISTOR_0201  [0201]
R26682  10K  RESISTOR_0201  [0201]
R26683  10K  RESISTOR_0201  [0201]
R26684  10K  RESISTOR_0201  [0201]
R26685  10K  RESISTOR_0201  [0201]
R26686  10K  RESISTOR_0201  [0201]
R26687  10K  RESISTOR_0201  [0201]
R26688  10K  RESISTOR_0201  [0201]
R26689  10K  RESISTOR_0201  [0201]
R26690  10K  RESISTOR_0201  [0201]
R26691  10K  RESISTOR_0201  [0201]
R26692  10K  RESISTOR_0201  [0201]
R26693  10K  RESISTOR_0201  [0201]
R26694  10K  RESISTOR_0201  [0201]
R26695  10K  RESISTOR_0201  [0201]
R26696  10K  RESISTOR_0201  [0201]
R26697  10K  RESISTOR_0201  [0201]
R26698  10K  RESISTOR_0201  [0201]
R26699  10K  RESISTOR_0201  [0201]
R26700  10K  RESISTOR_0201  [0201]
R26701  10K  RESISTOR_0201  [0201]
R26702  10K  RESISTOR_0201  [0201]
R26703  10K  RESISTOR_0201  [0201]
R26704  10K  RESISTOR_0201  [0201]
R26705  10K  RESISTOR_0201  [0201]
R26706  10K  RESISTOR_0201  [0201]
R26707  10K  RESISTOR_0201  [0201]
R26708  10K  RESISTOR_0201  [0201]
R26709  10K  RESISTOR_0201  [0201]
R26710  10K  RESISTOR_0201  [0201]
R26711  10K  RESISTOR_0201  [0201]
R26712  10K  RESISTOR_0201  [0201]
R26713  10K  RESISTOR_0201  [0201]
R26714  10K  RESISTOR_0201  [0201]
R26715  10K  RESISTOR_0201  [0201]
R26716  10K  RESISTOR_0201  [0201]
R26717  10K  RESISTOR_0201  [0201]
R26718  10K  RESISTOR_0201  [0201]
R26719  10K  RESISTOR_0201  [0201]
R26720  10K  RESISTOR_0201  [0201]
R26721  10K  RESISTOR_0201  [0201]
R26722  10K  RESISTOR_0201  [0201]
R26723  10K  RESISTOR_0201  [0201]
R26724  10K  RESISTOR_0201  [0201]
R26725  10K  RESISTOR_0201  [0201]
R26726  10K  RESISTOR_0201  [0201]
R26727  10K  RESISTOR_0201  [0201]
R26728  10K  RESISTOR_0201  [0201]
R26729  10K  RESISTOR_0201  [0201]
R26730  10K  RESISTOR_0201  [0201]
R26731  10K  RESISTOR_0201  [0201]
R26732  10K  RESISTOR_0201  [0201]
R26733  10K  RESISTOR_0201  [0201]
R26734  10K  RESISTOR_0201  [0201]
R26735  10K  RESISTOR_0201  [0201]
R26736  10K  RESISTOR_0201  [0201]
R26737  10K  RESISTOR_0201  [0201]
R26738  10K  RESISTOR_0201  [0201]
R26739  10K  RESISTOR_0201  [0201]
R26740  10K  RESISTOR_0201  [0201]
R26741  10K  RESISTOR_0201  [0201]
R26742  10K  RESISTOR_0201  [0201]
R26743  10K  RESISTOR_0201  [0201]
R26744  10K  RESISTOR_0201  [0201]
R26745  10K  RESISTOR_0201  [0201]
R26746  10K  RESISTOR_0201  [0201]
R26747  10K  RESISTOR_0201  [0201]
R26748  10K  RESISTOR_0201  [0201]
R26749  10K  RESISTOR_0201  [0201]
R26750  10K  RESISTOR_0201  [0201]
R26751  10K  RESISTOR_0201  [0201]
R26752  10K  RESISTOR_0201  [0201]
R26753  10K  RESISTOR_0201  [0201]
R26754  10K  RESISTOR_0201  [0201]
R26755  10K  RESISTOR_0201  [0201]
R26756  10K  RESISTOR_0201  [0201]
R26757  10K  RESISTOR_0201  [0201]
R26758  10K  RESISTOR_0201  [0201]
R26759  10K  RESISTOR_0201  [0201]
R26760  10K  RESISTOR_0201  [0201]
R26761  10K  RESISTOR_0201  [0201]
R26762  10K  RESISTOR_0201  [0201]
R26763  10K  RESISTOR_0201  [0201]
R26764  10K  RESISTOR_0201  [0201]
R26765  10K  RESISTOR_0201  [0201]
R26766  10K  RESISTOR_0201  [0201]
R26767  10K  RESISTOR_0201  [0201]
R26768  10K  RESISTOR_0201  [0201]
R26769  10K  RESISTOR_0201  [0201]
R26770  10K  RESISTOR_0201  [0201]
R26771  10K  RESISTOR_0201  [0201]
R26772  10K  RESISTOR_0201  [0201]
R26773  10K  RESISTOR_0201  [0201]
R26774  10K  RESISTOR_0201  [0201]
R26775  10K  RESISTOR_0201  [0201]
R26776  10K  RESISTOR_0201  [0201]
R26777  10K  RESISTOR_0201  [0201]
R26778  10K  RESISTOR_0201  [0201]
R26779  10K  RESISTOR_0201  [0201]
R26780  10K  RESISTOR_0201  [0201]
R26781  10K  RESISTOR_0201  [0201]
R26782  10K  RESISTOR_0201  [0201]
R26783  10K  RESISTOR_0201  [0201]
R26784  10K  RESISTOR_0201  [0201]
R26785  10K  RESISTOR_0201  [0201]
R26786  10K  RESISTOR_0201  [0201]
R26787  10K  RESISTOR_0201  [0201]
R26788  10K  RESISTOR_0201  [0201]
R26789  10K  RESISTOR_0201  [0201]
R26790  10K  RESISTOR_0201  [0201]
R26791  10K  RESISTOR_0201  [0201]
R26792  10K  RESISTOR_0201  [0201]
R26793  10K  RESISTOR_0201  [0201]
R26794  10K  RESISTOR_0201  [0201]
R26795  10K  RESISTOR_0201  [0201]
R26796  10K  RESISTOR_0201  [0201]
R26797  10K  RESISTOR_0201  [0201]
R26798  10K  RESISTOR_0201  [0201]
R26799  10K  RESISTOR_0201  [0201]
R26800  10K  RESISTOR_0201  [0201]
R26801  10K  RESISTOR_0201  [0201]
R26802  10K  RESISTOR_0201  [0201]
R26803  10K  RESISTOR_0201  [0201]
R26804  10K  RESISTOR_0201  [0201]
R26805  10K  RESISTOR_0201  [0201]
R26806  10K  RESISTOR_0201  [0201]
R26807  10K  RESISTOR_0201  [0201]
R26808  10K  RESISTOR_0201  [0201]
R26809  10K  RESISTOR_0201  [0201]
R26810  10K  RESISTOR_0201  [0201]
R26811  10K  RESISTOR_0201  [0201]
R26812  10K  RESISTOR_0201  [0201]
R26813  10K  RESISTOR_0201  [0201]
R26814  10K  RESISTOR_0201  [0201]
R26815  10K  RESISTOR_0201  [0201]
R26816  10K  RESISTOR_0201  [0201]
R26817  10K  RESISTOR_0201  [0201]
R26818  10K  RESISTOR_0201  [0201]
R26819  10K  RESISTOR_0201  [0201]
R26820  10K  RESISTOR_0201  [0201]
R26821  10K  RESISTOR_0201  [0201]
R26822  10K  RESISTOR_0201  [0201]
R26823  10K  RESISTOR_0201  [0201]
R26824  10K  RESISTOR_0201  [0201]
R26825  10K  RESISTOR_0201  [0201]
R26826  10K  RESISTOR_0201  [0201]
R26827  10K  RESISTOR_0201  [0201]
R26828  10K  RESISTOR_0201  [0201]
R26829  10K  RESISTOR_0201  [0201]
R26830  10K  RESISTOR_0201  [0201]
R26831  10K  RESISTOR_0201  [0201]
R26832  10K  RESISTOR_0201  [0201]
R26833  10K  RESISTOR_0201  [0201]
R26834  10K  RESISTOR_0201  [0201]
R26835  10K  RESISTOR_0201  [0201]
R26836  10K  RESISTOR_0201  [0201]
R26837  10K  RESISTOR_0201  [0201]
R26838  10K  RESISTOR_0201  [0201]
R26839  10K  RESISTOR_0201  [0201]
R26840  10K  RESISTOR_0201  [0201]
R26841  10K  RESISTOR_0201  [0201]
R26842  10K  RESISTOR_0201  [0201]
R26843  10K  RESISTOR_0201  [0201]
R26844  10K  RESISTOR_0201  [0201]
R26845  10K  RESISTOR_0201  [0201]
R26846  10K  RESISTOR_0201  [0201]
R26847  10K  RESISTOR_0201  [0201]
R26848  10K  RESISTOR_0201  [0201]
R26849  10K  RESISTOR_0201  [0201]
R26850  10K  RESISTOR_0201  [0201]
R26851  10K  RESISTOR_0201  [0201]
R26852  10K  RESISTOR_0201  [0201]
R26853  10K  RESISTOR_0201  [0201]
R26854  10K  RESISTOR_0201  [0201]
R26855  10K  RESISTOR_0201  [0201]
R26856  10K  RESISTOR_0201  [0201]
R26857  10K  RESISTOR_0201  [0201]
R26858  10K  RESISTOR_0201  [0201]
R26859  10K  RESISTOR_0201  [0201]
R26860  10K  RESISTOR_0201  [0201]
R26861  10K  RESISTOR_0201  [0201]
R26862  10K  RESISTOR_0201  [0201]
R26863  10K  RESISTOR_0201  [0201]
R26864  10K  RESISTOR_0201  [0201]
R26865  10K  RESISTOR_0201  [0201]
R26866  10K  RESISTOR_0201  [0201]
R26867  10K  RESISTOR_0201  [0201]
R26868  10K  RESISTOR_0201  [0201]
R26869  10K  RESISTOR_0201  [0201]
R26870  10K  RESISTOR_0201  [0201]
R26871  10K  RESISTOR_0201  [0201]
R26872  10K  RESISTOR_0201  [0201]
R26873  10K  RESISTOR_0201  [0201]
R26874  10K  RESISTOR_0201  [0201]
R26875  10K  RESISTOR_0201  [0201]
R26876  10K  RESISTOR_0201  [0201]
R26877  10K  RESISTOR_0201  [0201]
R26878  10K  RESISTOR_0201  [0201]
R26879  10K  RESISTOR_0201  [0201]
R26880  10K  RESISTOR_0201  [0201]
R26881  10K  RESISTOR_0201  [0201]
R26882  10K  RESISTOR_0201  [0201]
R26883  10K  RESISTOR_0201  [0201]
R26884  10K  RESISTOR_0201  [0201]
R26885  10K  RESISTOR_0201  [0201]
R26886  10K  RESISTOR_0201  [0201]
R26887  10K  RESISTOR_0201  [0201]
R26888  10K  RESISTOR_0201  [0201]
R26889  10K  RESISTOR_0201  [0201]
R26890  10K  RESISTOR_0201  [0201]
R26891  10K  RESISTOR_0201  [0201]
R26892  10K  RESISTOR_0201  [0201]
R26893  10K  RESISTOR_0201  [0201]
R26894  10K  RESISTOR_0201  [0201]
R26895  10K  RESISTOR_0201  [0201]
R26896  10K  RESISTOR_0201  [0201]
R26897  10K  RESISTOR_0201  [0201]
R26898  10K  RESISTOR_0201  [0201]
R26899  10K  RESISTOR_0201  [0201]
R26900  10K  RESISTOR_0201  [0201]
R26901  10K  RESISTOR_0201  [0201]
R26902  10K  RESISTOR_0201  [0201]
R26903  10K  RESISTOR_0201  [0201]
R26904  10K  RESISTOR_0201  [0201]
R26905  10K  RESISTOR_0201  [0201]
R26906  10K  RESISTOR_0201  [0201]
R26907  10K  RESISTOR_0201  [0201]
R26908  10K  RESISTOR_0201  [0201]
R26909  10K  RESISTOR_0201  [0201]
R26910  10K  RESISTOR_0201  [0201]
R26911  10K  RESISTOR_0201  [0201]
R26912  10K  RESISTOR_0201  [0201]
R26913  10K  RESISTOR_0201  [0201]
R26914  10K  RESISTOR_0201  [0201]
R26915  10K  RESISTOR_0201  [0201]
R26916  10K  RESISTOR_0201  [0201]
R26917  10K  RESISTOR_0201  [0201]
R26918  10K  RESISTOR_0201  [0201]
R26919  10K  RESISTOR_0201  [0201]
R26920  10K  RESISTOR_0201  [0201]
R26921  10K  RESISTOR_0201  [0201]
R26922  10K  RESISTOR_0201  [0201]
R26923  10K  RESISTOR_0201  [0201]
R26924  10K  RESISTOR_0201  [0201]
R26925  10K  RESISTOR_0201  [0201]
R26926  10K  RESISTOR_0201  [0201]
R26927  10K  RESISTOR_0201  [0201]
R26928  10K  RESISTOR_0201  [0201]
R26929  10K  RESISTOR_0201  [0201]
R26930  10K  RESISTOR_0201  [0201]
R26931  10K  RESISTOR_0201  [0201]
R26932  10K  RESISTOR_0201  [0201]
R26933  10K  RESISTOR_0201  [0201]
R26934  10K  RESISTOR_0201  [0201]
R26935  10K  RESISTOR_0201  [0201]
R26936  10K  RESISTOR_0201  [0201]
R26937  10K  RESISTOR_0201  [0201]
R26938  10K  RESISTOR_0201  [0201]
R26939  10K  RESISTOR_0201  [0201]
R26940  10K  RESISTOR_0201  [0201]
R26941  10K  RESISTOR_0201  [0201]
R26942  10K  RESISTOR_0201  [0201]
R26943  10K  RESISTOR_0201  [0201]
R26944  10K  RESISTOR_0201  [0201]
R26945  10K  RESISTOR_0201  [0201]
R26946  10K  RESISTOR_0201  [0201]
R26947  10K  RESISTOR_0201  [0201]
R26948  10K  RESISTOR_0201  [0201]
R26949  10K  RESISTOR_0201  [0201]
R26950  10K  RESISTOR_0201  [0201]
R26951  10K  RESISTOR_0201  [0201]
R26952  10K  RESISTOR_0201  [0201]
R26953  10K  RESISTOR_0201  [0201]
R26954  10K  RESISTOR_0201  [0201]
R26955  10K  RESISTOR_0201  [0201]
R26956  10K  RESISTOR_0201  [0201]
R26957  10K  RESISTOR_0201  [0201]
R26958  10K  RESISTOR_0201  [0201]
R26959  10K  RESISTOR_0201  [0201]
R26960  10K  RESISTOR_0201  [0201]
R26961  10K  RESISTOR_0201  [0201]
R26962  10K  RESISTOR_0201  [0201]
R26963  10K  RESISTOR_0201  [0201]
R26964  10K  RESISTOR_0201  [0201]
R26965  10K  RESISTOR_0201  [0201]
R26966  10K  RESISTOR_0201  [0201]
R26967  10K  RESISTOR_0201  [0201]
R26968  10K  RESISTOR_0201  [0201]
R26969  10K  RESISTOR_0201  [0201]
R26970  10K  RESISTOR_0201  [0201]
R26971  10K  RESISTOR_0201  [0201]
R26972  10K  RESISTOR_0201  [0201]
R26973  10K  RESISTOR_0201  [0201]
R26974  10K  RESISTOR_0201  [0201]
R26975  10K  RESISTOR_0201  [0201]
R26976  10K  RESISTOR_0201  [0201]
R26977  10K  RESISTOR_0201  [0201]
R26978  10K  RESISTOR_0201  [0201]
R26979  10K  RESISTOR_0201  [0201]
R26980  10K  RESISTOR_0201  [0201]
R26981  10K  RESISTOR_0201  [0201]
R26982  10K  RESISTOR_0201  [0201]
R26983  10K  RESISTOR_0201  [0201]
R26984  10K  RESISTOR_0201  [0201]
R26985  10K  RESISTOR_0201  [0201]
R26986  10K  RESISTOR_0201  [0201]
R26987  10K  RESISTOR_0201  [0201]
R26988  10K  RESISTOR_0201  [0201]
R26989  10K  RESISTOR_0201  [0201]
R26990  10K  RESISTOR_0201  [0201]
R26991  10K  RESISTOR_0201  [0201]
R26992  10K  RESISTOR_0201  [0201]
R26993  10K  RESISTOR_0201  [0201]
R26994  10K  RESISTOR_0201  [0201]
R26995  10K  RESISTOR_0201  [0201]
R26996  10K  RESISTOR_0201  [0201]
R26997  10K  RESISTOR_0201  [0201]
R26998  10K  RESISTOR_0201  [0201]
R26999  10K  RESISTOR_0201  [0201]
R27000  10K  RESISTOR_0201  [0201]
R27001  10K  RESISTOR_0201  [0201]
R27002  10K  RESISTOR_0201  [0201]
R27003  10K  RESISTOR_0201  [0201]
R27004  10K  RESISTOR_0201  [0201]
R27005  10K  RESISTOR_0201  [0201]
R27006  10K  RESISTOR_0201  [0201]
R27007  10K  RESISTOR_0201  [0201]
R27008  10K  RESISTOR_0201  [0201]
R27009  10K  RESISTOR_0201  [0201]
R27010  10K  RESISTOR_0201  [0201]
R27011  10K  RESISTOR_0201  [0201]
R27012  10K  RESISTOR_0201  [0201]
R27013  10K  RESISTOR_0201  [0201]
R27014  10K  RESISTOR_0201  [0201]
R27015  10K  RESISTOR_0201  [0201]
R27016  10K  RESISTOR_0201  [0201]
R27017  10K  RESISTOR_0201  [0201]
R27018  10K  RESISTOR_0201  [0201]
R27019  10K  RESISTOR_0201  [0201]
R27020  10K  RESISTOR_0201  [0201]
R27021  10K  RESISTOR_0201  [0201]
R27022  10K  RESISTOR_0201  [0201]
R27023  10K  RESISTOR_0201  [0201]
R27024  10K  RESISTOR_0201  [0201]
R27025  10K  RESISTOR_0201  [0201]
R27026  10K  RESISTOR_0201  [0201]
R27027  10K  RESISTOR_0201  [0201]
R27028  10K  RESISTOR_0201  [0201]
R27029  10K  RESISTOR_0201  [0201]
R27030  10K  RESISTOR_0201  [0201]
R27031  10K  RESISTOR_0201  [0201]
R27032  10K  RESISTOR_0201  [0201]
R27033  10K  RESISTOR_0201  [0201]
R27034  10K  RESISTOR_0201  [0201]
R27035  10K  RESISTOR_0201  [0201]
R27036  10K  RESISTOR_0201  [0201]
R27037  10K  RESISTOR_0201  [0201]
R27038  10K  RESISTOR_0201  [0201]
R27039  10K  RESISTOR_0201  [0201]
R27040  10K  RESISTOR_0201  [0201]
R27041  10K  RESISTOR_0201  [0201]
R27042  10K  RESISTOR_0201  [0201]
R27043  10K  RESISTOR_0201  [0201]
R27044  10K  RESISTOR_0201  [0201]
R27045  10K  RESISTOR_0201  [0201]
R27046  10K  RESISTOR_0201  [0201]
R27047  10K  RESISTOR_0201  [0201]
R27048  10K  RESISTOR_0201  [0201]
R27049  10K  RESISTOR_0201  [0201]
R27050  10K  RESISTOR_0201  [0201]
R27051  10K  RESISTOR_0201  [0201]
R27052  10K  RESISTOR_0201  [0201]
R27053  10K  RESISTOR_0201  [0201]
R27054  10K  RESISTOR_0201  [0201]
R27055  10K  RESISTOR_0201  [0201]
R27056  10K  RESISTOR_0201  [0201]
R27057  10K  RESISTOR_0201  [0201]
R27058  10K  RESISTOR_0201  [0201]
R27059  10K  RESISTOR_0201  [0201]
R27060  10K  RESISTOR_0201  [0201]
R27061  10K  RESISTOR_0201  [0201]
R27062  10K  RESISTOR_0201  [0201]
R27063  10K  RESISTOR_0201  [0201]
R27064  10K  RESISTOR_0201  [0201]
R27065  10K  RESISTOR_0201  [0201]
R27066  10K  RESISTOR_0201  [0201]
R27067  10K  RESISTOR_0201  [0201]
R27068  10K  RESISTOR_0201  [0201]
R27069  10K  RESISTOR_0201  [0201]
R27070  10K  RESISTOR_0201  [0201]
R27071  10K  RESISTOR_0201  [0201]
R27072  10K  RESISTOR_0201  [0201]
R27073  10K  RESISTOR_0201  [0201]
R27074  10K  RESISTOR_0201  [0201]
R27075  10K  RESISTOR_0201  [0201]
R27076  10K  RESISTOR_0201  [0201]
R27077  10K  RESISTOR_0201  [0201]
R27078  10K  RESISTOR_0201  [0201]
R27079  10K  RESISTOR_0201  [0201]
R27080  10K  RESISTOR_0201  [0201]
R27081  10K  RESISTOR_0201  [0201]
R27082  10K  RESISTOR_0201  [0201]
R27083  10K  RESISTOR_0201  [0201]
R27084  10K  RESISTOR_0201  [0201]
R27085  10K  RESISTOR_0201  [0201]
R27086  10K  RESISTOR_0201  [0201]
R27087  10K  RESISTOR_0201  [0201]
R27088  10K  RESISTOR_0201  [0201]
R27089  10K  RESISTOR_0201  [0201]
R27090  10K  RESISTOR_0201  [0201]
R27091  10K  RESISTOR_0201  [0201]
R27092  10K  RESISTOR_0201  [0201]
R27093  10K  RESISTOR_0201  [0201]
R27094  10K  RESISTOR_0201  [0201]
R27095  10K  RESISTOR_0201  [0201]
R27096  10K  RESISTOR_0201  [0201]
R27097  10K  RESISTOR_0201  [0201]
R27098  10K  RESISTOR_0201  [0201]
R27099  10K  RESISTOR_0201  [0201]
R27100  10K  RESISTOR_0201  [0201]
R27101  10K  RESISTOR_0201  [0201]
R27102  10K  RESISTOR_0201  [0201]
R27103  10K  RESISTOR_0201  [0201]
R27104  10K  RESISTOR_0201  [0201]
R27105  10K  RESISTOR_0201  [0201]
R27106  10K  RESISTOR_0201  [0201]
R27107  10K  RESISTOR_0201  [0201]
R27108  10K  RESISTOR_0201  [0201]
R27109  10K  RESISTOR_0201  [0201]
R27110  10K  RESISTOR_0201  [0201]
R27111  10K  RESISTOR_0201  [0201]
R27112  10K  RESISTOR_0201  [0201]
R27113  10K  RESISTOR_0201  [0201]
R27114  10K  RESISTOR_0201  [0201]
R27115  10K  RESISTOR_0201  [0201]
R27116  10K  RESISTOR_0201  [0201]
R27117  10K  RESISTOR_0201  [0201]
R27118  10K  RESISTOR_0201  [0201]
R27119  10K  RESISTOR_0201  [0201]
R27120  10K  RESISTOR_0201  [0201]
R27121  10K  RESISTOR_0201  [0201]
R27122  10K  RESISTOR_0201  [0201]
R27123  10K  RESISTOR_0201  [0201]
R27124  10K  RESISTOR_0201  [0201]
R27125  10K  RESISTOR_0201  [0201]
R27126  10K  RESISTOR_0201  [0201]
R27127  10K  RESISTOR_0201  [0201]
R27128  10K  RESISTOR_0201  [0201]
R27129  10K  RESISTOR_0201  [0201]
R27130  10K  RESISTOR_0201  [0201]
R27131  10K  RESISTOR_0201  [0201]
R27132  10K  RESISTOR_0201  [0201]
R27133  10K  RESISTOR_0201  [0201]
R27134  10K  RESISTOR_0201  [0201]
R27135  10K  RESISTOR_0201  [0201]
R27136  10K  RESISTOR_0201  [0201]
R27137  10K  RESISTOR_0201  [0201]
R27138  10K  RESISTOR_0201  [0201]
R27139  10K  RESISTOR_0201  [0201]
R27140  10K  RESISTOR_0201  [0201]
R27141  10K  RESISTOR_0201  [0201]
R27142  10K  RESISTOR_0201  [0201]
R27143  10K  RESISTOR_0201  [0201]
R27144  10K  RESISTOR_0201  [0201]
R27145  10K  RESISTOR_0201  [0201]
R27146  10K  RESISTOR_0201  [0201]
R27147  10K  RESISTOR_0201  [0201]
R27148  10K  RESISTOR_0201  [0201]
R27149  10K  RESISTOR_0201  [0201]
R27150  10K  RESISTOR_0201  [0201]
R27151  10K  RESISTOR_0201  [0201]
R27152  10K  RESISTOR_0201  [0201]
R27153  10K  RESISTOR_0201  [0201]
R27154  10K  RESISTOR_0201  [0201]
R27155  10K  RESISTOR_0201  [0201]
R27156  10K  RESISTOR_0201  [0201]
R27157  10K  RESISTOR_0201  [0201]
R27158  10K  RESISTOR_0201  [0201]
R27159  10K  RESISTOR_0201  [0201]
R27160  10K  RESISTOR_0201  [0201]
R27161  10K  RESISTOR_0201  [0201]
R27162  10K  RESISTOR_0201  [0201]
R27163  10K  RESISTOR_0201  [0201]
R27164  10K  RESISTOR_0201  [0201]
R27165  10K  RESISTOR_0201  [0201]
R27166  10K  RESISTOR_0201  [0201]
R27167  10K  RESISTOR_0201  [0201]
R27168  10K  RESISTOR_0201  [0201]
R27169  10K  RESISTOR_0201  [0201]
R27170  10K  RESISTOR_0201  [0201]
R27171  10K  RESISTOR_0201  [0201]
R27172  10K  RESISTOR_0201  [0201]
R27173  10K  RESISTOR_0201  [0201]
R27174  10K  RESISTOR_0201  [0201]
R27175  10K  RESISTOR_0201  [0201]
R27176  10K  RESISTOR_0201  [0201]
R27177  10K  RESISTOR_0201  [0201]
R27178  10K  RESISTOR_0201  [0201]
R27179  10K  RESISTOR_0201  [0201]
R27180  10K  RESISTOR_0201  [0201]
R27181  10K  RESISTOR_0201  [0201]
R27182  10K  RESISTOR_0201  [0201]
R27183  10K  RESISTOR_0201  [0201]
R27184  10K  RESISTOR_0201  [0201]
R27185  10K  RESISTOR_0201  [0201]
R27186  10K  RESISTOR_0201  [0201]
R27187  10K  RESISTOR_0201  [0201]
R27188  10K  RESISTOR_0201  [0201]
R27189  10K  RESISTOR_0201  [0201]
R27190  10K  RESISTOR_0201  [0201]
R27191  10K  RESISTOR_0201  [0201]
R27192  10K  RESISTOR_0201  [0201]
R27193  10K  RESISTOR_0201  [0201]
R27194  10K  RESISTOR_0201  [0201]
R27195  10K  RESISTOR_0201  [0201]
R27196  10K  RESISTOR_0201  [0201]
R27197  10K  RESISTOR_0201  [0201]
R27198  10K  RESISTOR_0201  [0201]
R27199  10K  RESISTOR_0201  [0201]
R27200  10K  RESISTOR_0201  [0201]
R27201  10K  RESISTOR_0201  [0201]
R27202  10K  RESISTOR_0201  [0201]
R27203  10K  RESISTOR_0201  [0201]
R27204  10K  RESISTOR_0201  [0201]
R27205  10K  RESISTOR_0201  [0201]
R27206  10K  RESISTOR_0201  [0201]
R27207  10K  RESISTOR_0201  [0201]
R27208  10K  RESISTOR_0201  [0201]
R27209  10K  RESISTOR_0201  [0201]
R27210  10K  RESISTOR_0201  [0201]
R27211  10K  RESISTOR_0201  [0201]
R27212  10K  RESISTOR_0201  [0201]
R27213  10K  RESISTOR_0201  [0201]
R27214  10K  RESISTOR_0201  [0201]
R27215  10K  RESISTOR_0201  [0201]
R27216  10K  RESISTOR_0201  [0201]
R27217  10K  RESISTOR_0201  [0201]
R27218  10K  RESISTOR_0201  [0201]
R27219  10K  RESISTOR_0201  [0201]
R27220  10K  RESISTOR_0201  [0201]
R27221  10K  RESISTOR_0201  [0201]
R27222  10K  RESISTOR_0201  [0201]
R27223  10K  RESISTOR_0201  [0201]
R27224  10K  RESISTOR_0201  [0201]
R27225  10K  RESISTOR_0201  [0201]
R27226  10K  RESISTOR_0201  [0201]
R27227  10K  RESISTOR_0201  [0201]
R27228  10K  RESISTOR_0201  [0201]
R27229  10K  RESISTOR_0201  [0201]
R27230  10K  RESISTOR_0201  [0201]
R27231  10K  RESISTOR_0201  [0201]
R27232  10K  RESISTOR_0201  [0201]
R27233  10K  RESISTOR_0201  [0201]
R27234  10K  RESISTOR_0201  [0201]
R27235  10K  RESISTOR_0201  [0201]
R27236  10K  RESISTOR_0201  [0201]
R27237  10K  RESISTOR_0201  [0201]
R27238  10K  RESISTOR_0201  [0201]
R27239  10K  RESISTOR_0201  [0201]
R27240  10K  RESISTOR_0201  [0201]
R27241  10K  RESISTOR_0201  [0201]
R27242  10K  RESISTOR_0201  [0201]
R27243  10K  RESISTOR_0201  [0201]
R27244  10K  RESISTOR_0201  [0201]
R27245  10K  RESISTOR_0201  [0201]
R27246  10K  RESISTOR_0201  [0201]
R27247  10K  RESISTOR_0201  [0201]
R27248  10K  RESISTOR_0201  [0201]
R27249  10K  RESISTOR_0201  [0201]
R27250  10K  RESISTOR_0201  [0201]
R27251  10K  RESISTOR_0201  [0201]
R27252  10K  RESISTOR_0201  [0201]
R27253  10K  RESISTOR_0201  [0201]
R27254  10K  RESISTOR_0201  [0201]
R27255  10K  RESISTOR_0201  [0201]
R27256  10K  RESISTOR_0201  [0201]
R27257  10K  RESISTOR_0201  [0201]
R27258  10K  RESISTOR_0201  [0201]
R27259  10K  RESISTOR_0201  [0201]
R27260  10K  RESISTOR_0201  [0201]
R27261  10K  RESISTOR_0201  [0201]
R27262  10K  RESISTOR_0201  [0201]
R27263  10K  RESISTOR_0201  [0201]
R27264  10K  RESISTOR_0201  [0201]
R27265  10K  RESISTOR_0201  [0201]
R27266  10K  RESISTOR_0201  [0201]
R27267  10K  RESISTOR_0201  [0201]
R27268  10K  RESISTOR_0201  [0201]
R27269  10K  RESISTOR_0201  [0201]
R27270  10K  RESISTOR_0201  [0201]
R27271  10K  RESISTOR_0201  [0201]
R27272  10K  RESISTOR_0201  [0201]
R27273  10K  RESISTOR_0201  [0201]
R27274  10K  RESISTOR_0201  [0201]
R27275  10K  RESISTOR_0201  [0201]
R27276  10K  RESISTOR_0201  [0201]
R27277  10K  RESISTOR_0201  [0201]